# Altium schematic sheet Sheet4.SchDoc
size A4
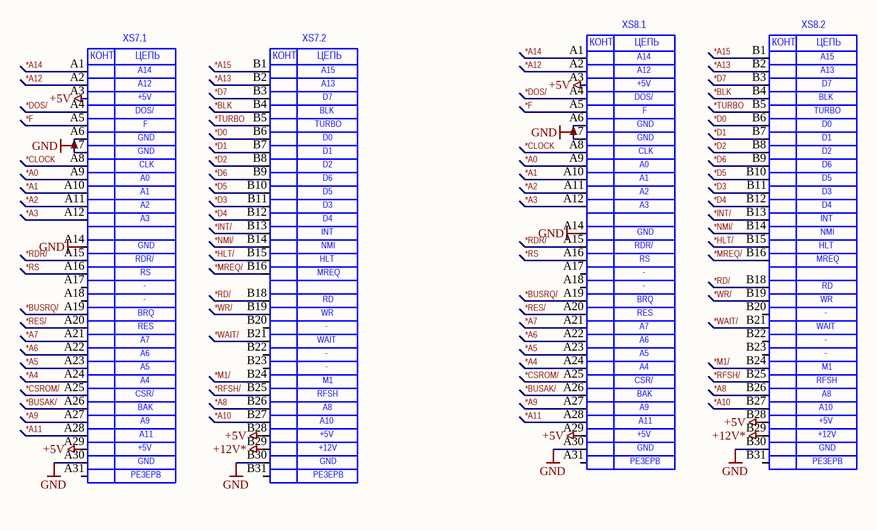
[diagram p0: Sheet4.SchDoc]

## Parts
XS7  (no value)  [SLOT62_ZXSLOT(Primary)]  (parts A,B,C,D,E,F,G,H,I,J,K,L,N,O,P,Q,R,S,T,U,V,W,X,Y,Z,27,28,29,30,31,32,33,34,35,36,37,38,39,40,41,42,43,44,45,46,47,49,50,51,52,53,54,55,56,57,58,59,60,61,62 of 62)
XS8  (no value)  [SLOT62_ZXSLOT(Primary)]  (parts A,B,C,D,E,F,G,H,I,J,K,L,N,O,P,Q,R,S,T,U,V,W,X,Y,Z,27,28,29,30,31,32,33,34,35,36,37,38,39,40,41,42,43,44,45,46,47,49,50,51,52,53,54,55,56,57,58,59,60,61,62 of 62)

## Nets
+5V: XS7.A3 XS7.A29 XS7.B28 XS8.A3 XS8.A29 XS8.B28
+12V*: XS7.B29 XS8.B29
GND: XS7.A6 XS7.A7 XS7.A14 XS7.A30 XS7.B30 XS8.A6 XS8.A7 XS8.A14 XS8.A30 XS8.B30
*A0: XS7.A9 XS8.A9
*A1: XS7.A10 XS8.A10
*A2: XS7.A11 XS8.A11
*A3: XS7.A12 XS8.A12
*A4: XS7.A24 XS8.A24
*A5: XS7.A23 XS8.A23
*A6: XS7.A22 XS8.A22
*A7: XS7.A21 XS8.A21
*A8: XS7.B26 XS8.B26
*A9: XS7.A27 XS8.A27
*A10: XS7.B27 XS8.B27
*A11: XS7.A28 XS8.A28
*A12: XS7.A2 XS8.A2
*A13: XS7.B2 XS8.B2
*A14: XS7.A1 XS8.A1
*A15: XS7.B1 XS8.B1
*BLK: XS7.B4 XS8.B4
*BUSAK/: XS7.A26 XS8.A26
*BUSRQ/: XS7.A19 XS8.A19
*CLOCK: XS7.A8 XS8.A8
*CSROM/: XS7.A25 XS8.A25
*D0: XS7.B6 XS8.B6
*D1: XS7.B7 XS8.B7
*D2: XS7.B8 XS8.B8
*D3: XS7.B11 XS8.B11
*D4: XS7.B12 XS8.B12
*D5: XS7.B10 XS8.B10
*D6: XS7.B9 XS8.B9
*D7: XS7.B3 XS8.B3
*DOS/: XS7.A4 XS8.A4
*F: XS7.A5 XS8.A5
*HLT/: XS7.B15 XS8.B15
*INT/: XS7.B13 XS8.B13
*M1/: XS7.B24 XS8.B24
*MREQ/: XS7.B16 XS8.B16
*NMI/: XS7.B14 XS8.B14
*RD/: XS7.B18 XS8.B18
*RDR/: XS7.A15 XS8.A15
*RES/: XS7.A20 XS8.A20
*RFSH/: XS7.B25 XS8.B25
*RS: XS7.A16 XS8.A16
*TURBO: XS7.B5 XS8.B5
*WAIT/: XS7.B21 XS8.B21
*WR/: XS7.B19 XS8.B19

Not connected (* = marked no-connect by the designer): XS7 A17 A18 A31 B20 B22 B23 B31; XS8 A17 A18 A31 B20 B22 B23 B31

## Notes on the sheet
- (near XS7) XS7.1
- (near XS7) XS7.2
- (near XS8) КОНТ.
- (near XS8) XS8.1
- (near XS8) ЦЕПЬ
- (near XS8) XS8.2
- (near XS7) КОНТ.
- (near XS7) ЦЕПЬ
- (near XS7) DOS/
- (near XS7) A14
- (near XS7) A12
- (near XS7) +5V
- (near XS7) BLK
- (near XS7) A15
- (near XS7) A13
- (near XS7) D7
- (near XS8) DOS/
- (near XS8) A14
- (near XS8) A12
- (near XS8) +5V
- F
- (near XS8) TURBO
- (near XS8) BLK
- (near XS8) A15
- (near XS8) A13
- (near XS8) D7
- (near XS7) GND
- (near XS7) CLK
- (near XS7) A0
- (near XS7) TURBO
- (near XS7) D0
- (near XS7) D1
- (near XS7) D2
- (near XS7) D6
- (near XS8) GND
- (near XS8) CLK
- (near XS8) A0
- (near XS8) A1
- (near XS8) D0
- (near XS8) D1
- (near XS8) D2
- (near XS8) D6
- (near XS8) D5
- (near XS7) A1
- (near XS7) A2
- (near XS7) A3
- (near XS7) INT
- (near XS7) NMI
- (near XS7) D5
- (near XS7) D3
- (near XS7) D4
- (near XS8) RDR/
- (near XS8) A2
- (near XS8) A3
- (near XS8) HLT
- (near XS8) INT
- (near XS8) NMI
- (near XS8) D3
- (near XS8) D4
- (near XS7) RDR/
- (near XS7) BRQ
- (near XS7) RS
- -
- (near XS7) MREQ
- (near XS7) HLT
- (near XS7) WR
- (near XS7) RD
- (near XS8) BRQ
- (near XS8) RES
- (near XS8) RS
- (near XS8) MREQ
- (near XS8) WR
- (near XS8) RD
- (near XS7) RES
- (near XS7) A7
- (near XS7) A6
- (near XS7) A5
- (near XS7) A4
- (near XS7) WAIT
- (near XS7) M1
- (near XS8) CSR/
- (near XS8) A7
- (near XS8) A6
- (near XS8) A5
- (near XS8) A4
- (near XS8) WAIT
- (near XS8) RFSH
- (near XS8) M1
- (near XS7) CSR/
- (near XS7) BAK
- (near XS7) A11
- (near XS7) A9
- (near XS7) RFSH
- (near XS7) +12V
- (near XS7) A10
- (near XS7) A8
- (near XS8) BAK
- (near XS8) A11
- (near XS8) A9
- (near XS8) +12V
- (near XS8) A10
- (near XS8) A8
- (near XS7) РЕЗЕРВ
- (near XS8) РЕЗЕРВ

## Library data of the parts
XS7 XS8 = NEMOBUS: Type: NEMOBUS